# EasyEDA Pro project 定时喝水PCB.eprj, board 参考PCB1_1
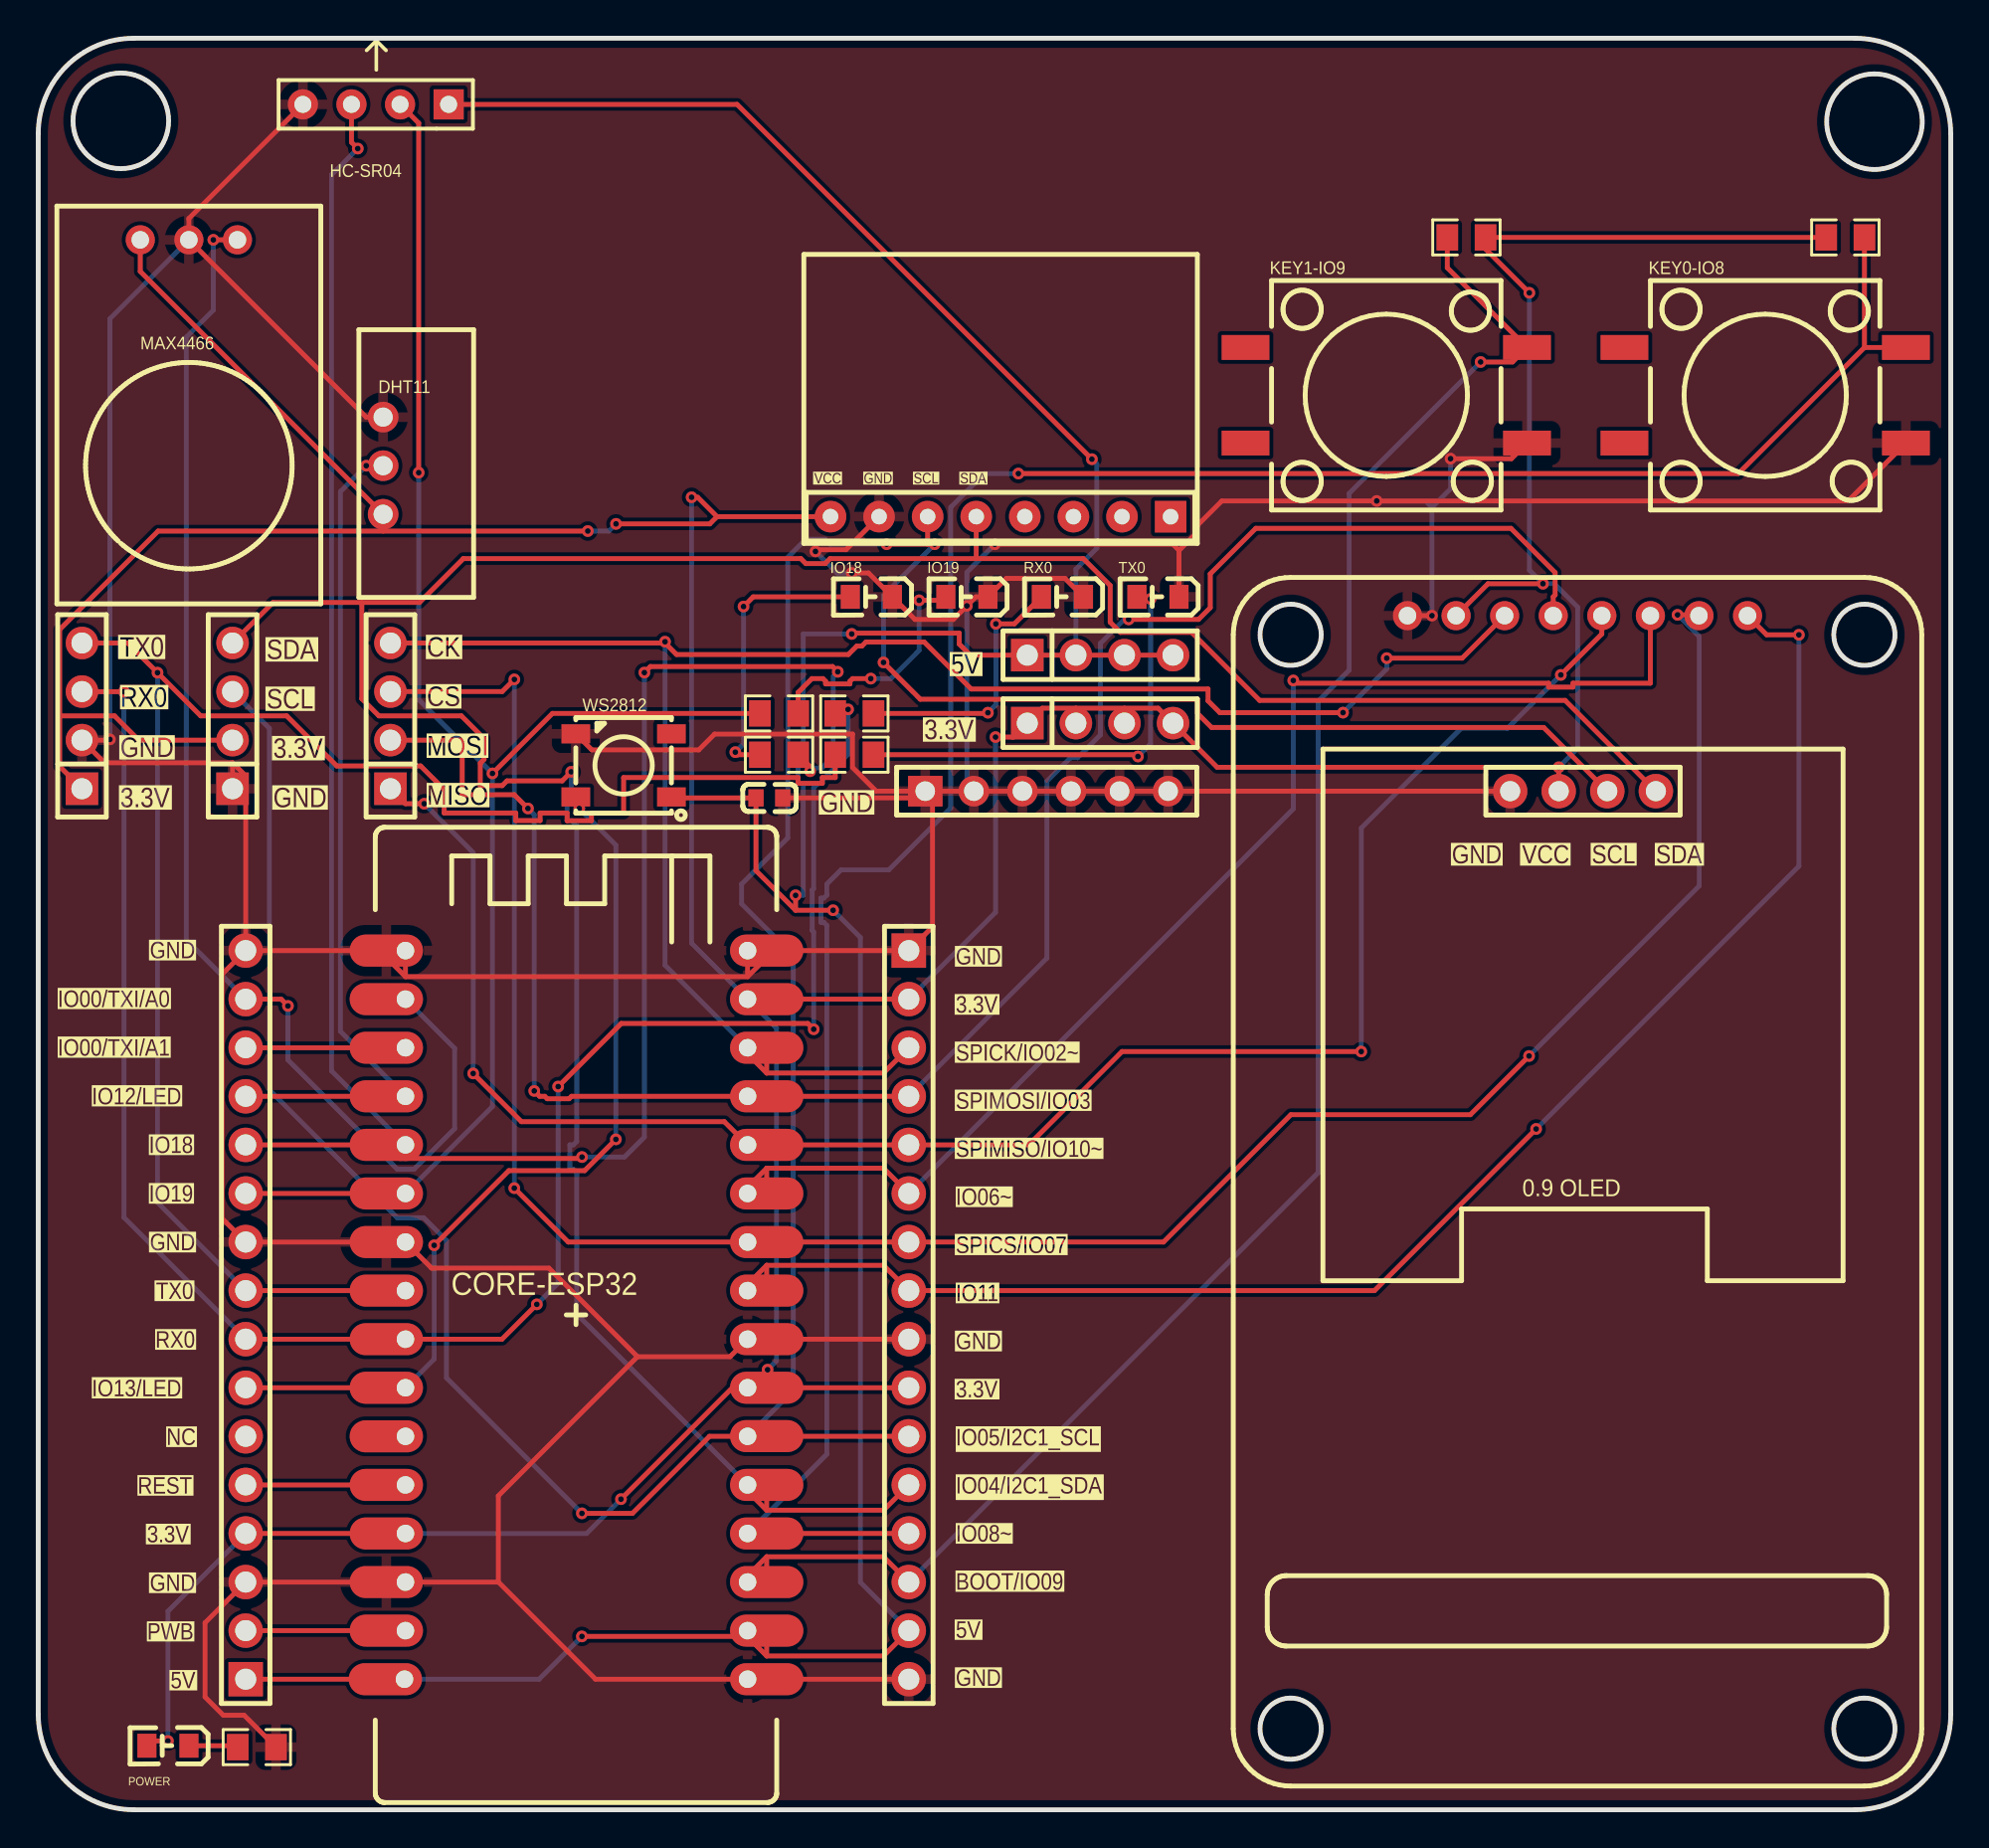
[diagram p4: board, top side]
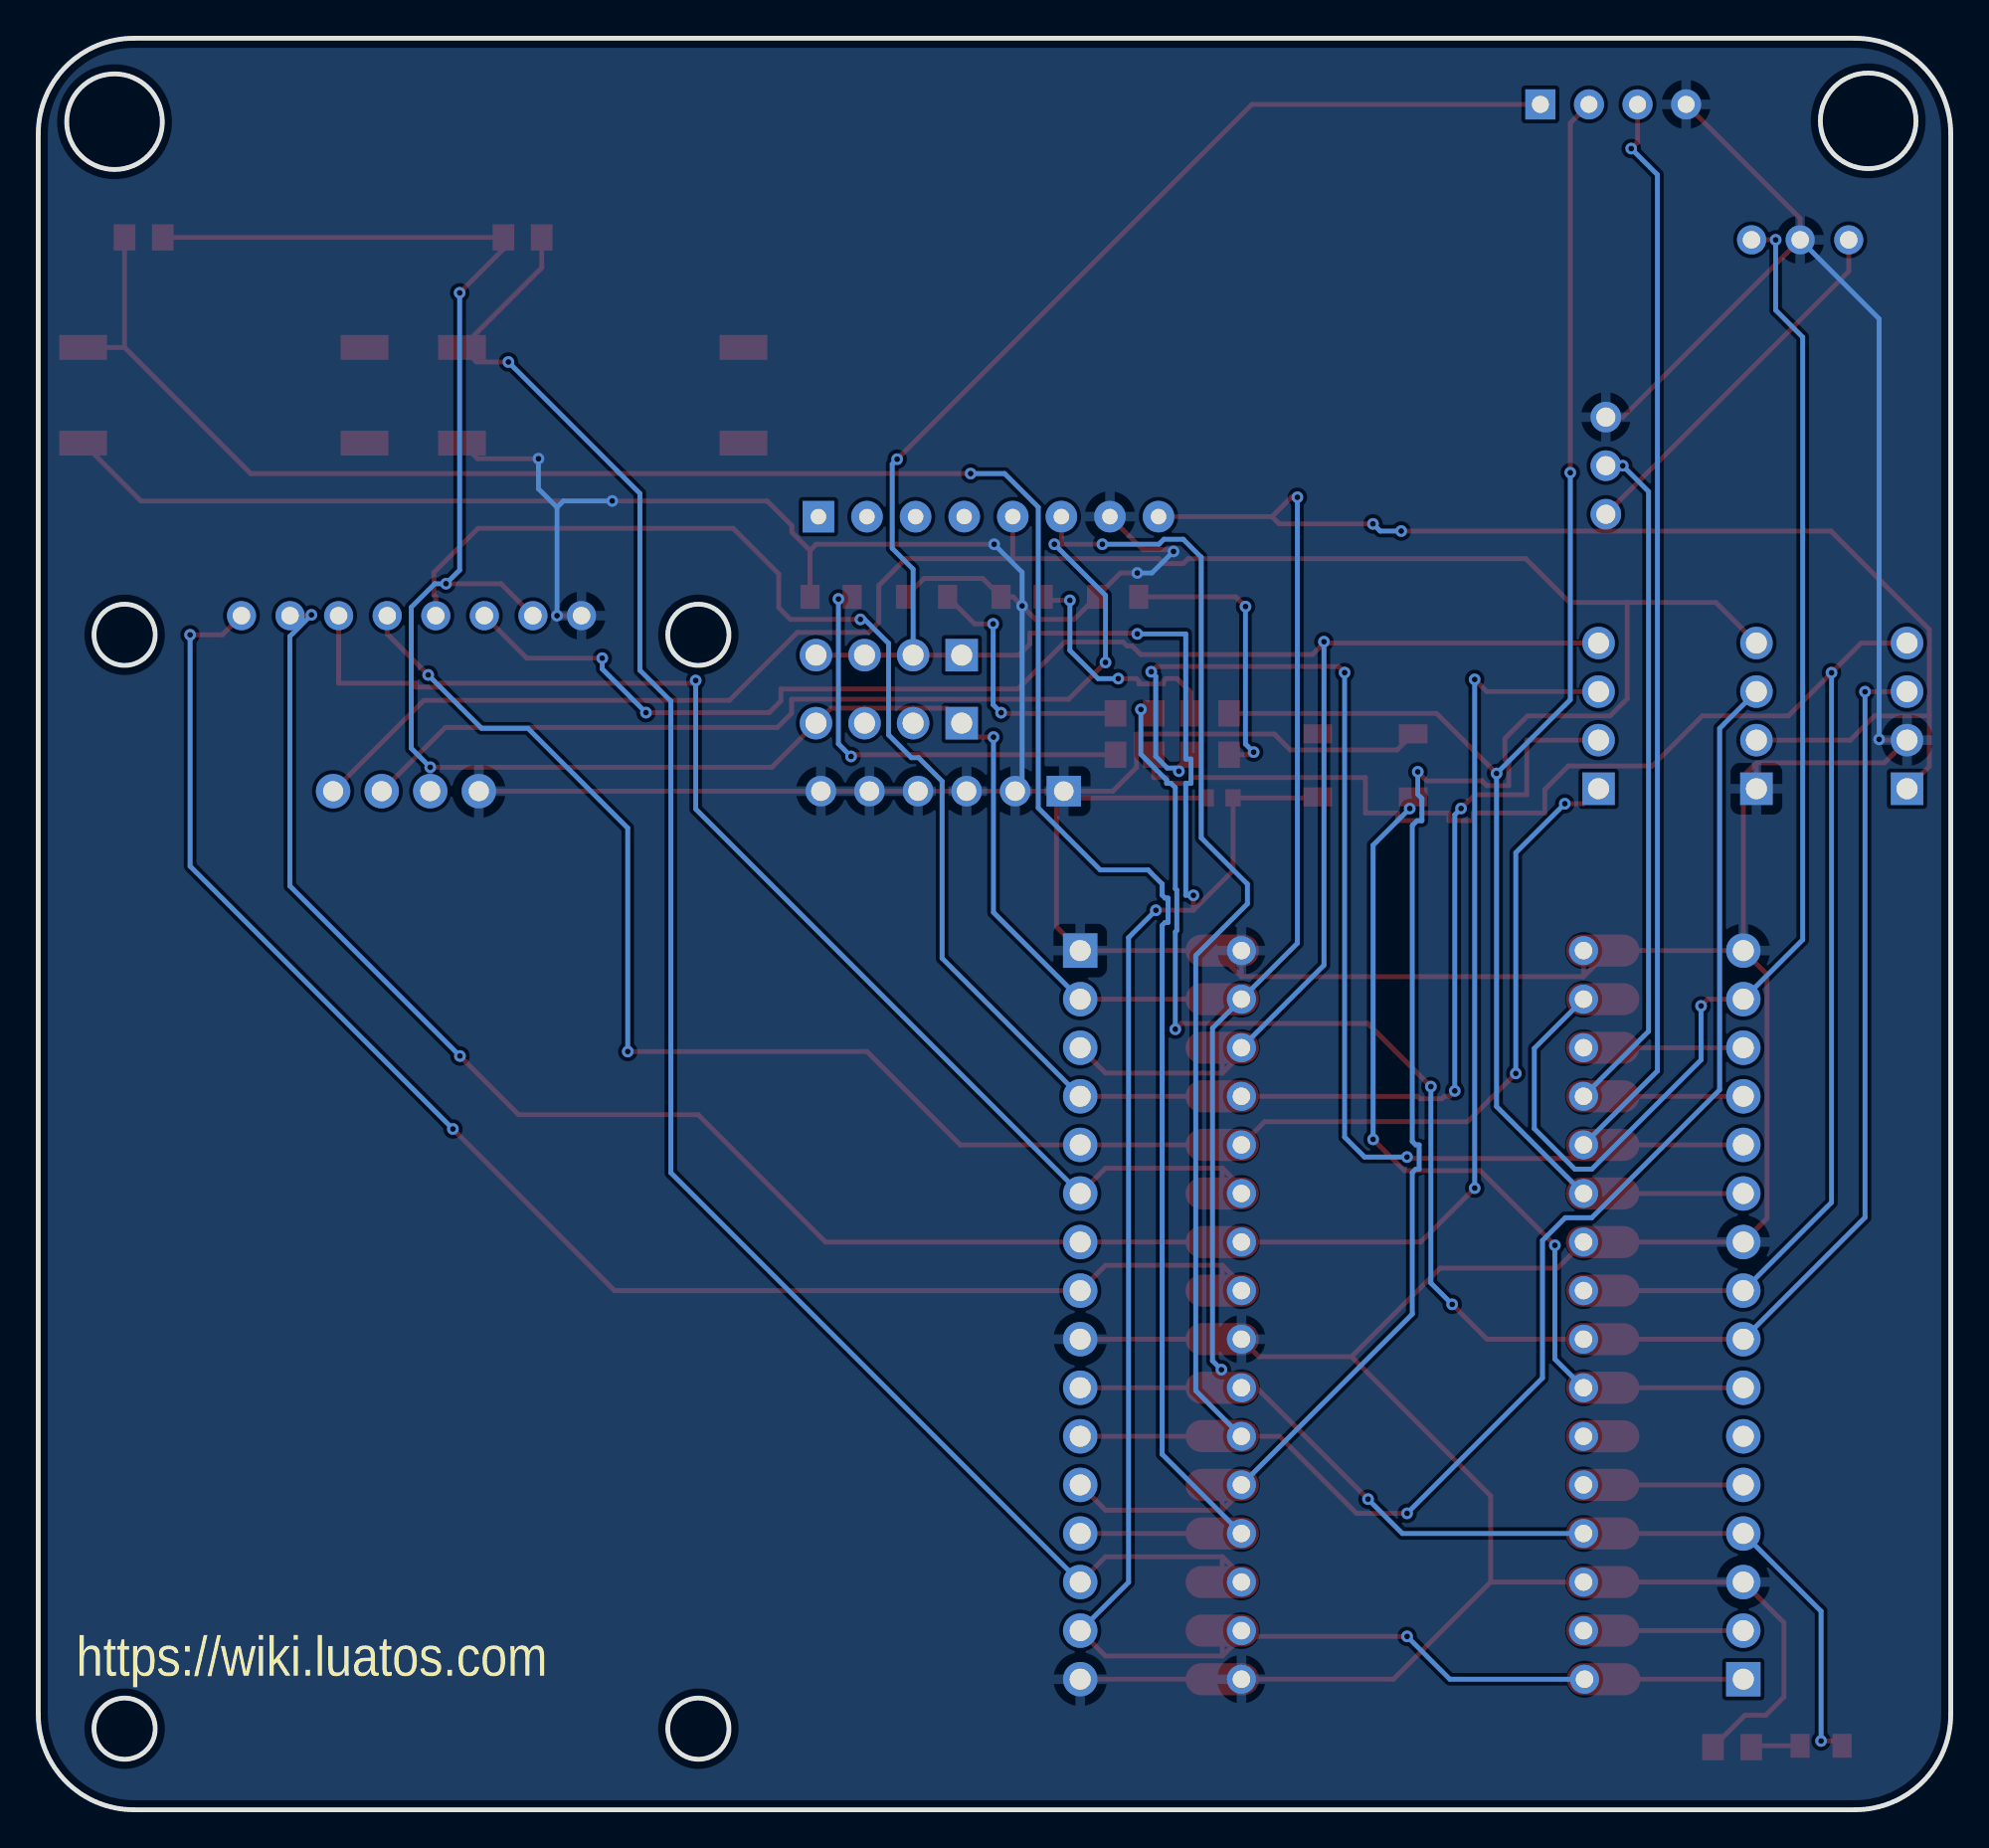
[diagram p5: board, bottom side, seen from below]

Outline 100 x 92.63 mm; copper layers: Top Layer, Bottom Layer. Coordinates in mm from the lower left corner of the outline.
Outline path: circle c4.32,88.32 r2.5 ; circle c65.48,61.44 r1.6 ; circle c65.48,4.24 r1.6 ; circle c95.48,61.44 r1.6 ; circle c95.48,4.24 r1.6 ; circle c96.01,88.27 r2.5 ; 0,87.63 arc(1.46,91.17) 5,92.63 95,92.63 arc(98.54,91.17) 100,87.63 100,5 arc(98.54,1.46) 95,0 5,0 arc(1.46,1.46) 0,5 0,87.63
Stack: SUBSTRATE1 0.32mm FR-4 er 4.8 / Bottom Layer 0.035mm

## Design rules (mm)
spacing safeClearance (default): track to track 0.152, other pairs 0.152 to 0.3
track width trackWidth (default): min 0.127, default 0.254, max 2.54
differential pair differentialPair (default): width min 0.127, default 0.254, max 2.54; gap min 0.152, default 0.152
via viaSize (default): diameter min 0.5, default 0.61, max 10; hole min 0.3, default 0.305, max 6

## Placement (name value [footprint] x y rotation side)
0.9 OLED  HS96L03W2C03  [OLED-TH_L27.8-W27.2-P2.54_C9900033791]  80.77 53.26 0 top
C1  CAP_0603  [C0603]  38.23 52.91 180 top
CORE-ESP32  ESP32C3-合宙  [esp32c3-合宙]  28.12 25.89 0 top
DHT11  -  [DHT11]  16.76 77.39 0 top
H1  HDR-M_2.54_1x16P  [HDR-TH_16P-P2.54-V-M]  10.85 25.88 90 top
H2  HDR-M_2.54_1x16P  [HDR-TH_16P-P2.54-V-M]  45.52 25.88 270 top
H4  HDR-M_2.54_1x4P  [HDR-TH_4P-P2.54-V-M]  55.53 60.38 0 top
H6  HDR-M_2.54_1x4P  [HDR-TH_4P-P2.54-V-M]  55.53 56.82 0 top
H7  HDR-F_2.54_1x6P  [HDR-TH_6P-P2.54-V-F]  52.73 53.26 0 top
H8  HDR-F_2.54_1x4P  [HDR-TH_4P-P2.54-V-F]  2.29 57.2 90 top
H9  HDR-F_2.54_1x4P  [HDR-TH_4P-P2.54-V-F]  10.16 57.2 90 top
H10  HDR-F_2.54_1x4P  [HDR-TH_4P-P2.54-V-F]  18.42 57.2 90 top
HC-SR04  -  [HC-SR04]  17.68 89.2 180 top
IMPORTED_IMAGE  -  [IMPORTED_IMAGE]  97.41 30.02 0 bottom
IO18  XL-2012SURC  [LED0805-RD_RED]  43.56 63.42 180 top
IO19  XL-2012SURC  [LED0805-RD_RED]  48.56 63.42 180 top
KEY0-IO8  SWS12X12  [SW-SMD_4P-L12.0-W12.0-P5.00-LS15.4]  90.3 73.96 180 top
KEY1-IO9  SWS12X12  [SW-SMD_4P-L12.0-W12.0-P5.00-LS15.4]  70.49 73.96 180 top
MAX4466  -  [MAX4466]  7.87 73.46 270 top
MPU6050  MPU6050模块  [MPU6050]  60.61 66.22 180 top
NOREF  -  [R0805]  38.74 57.33 180 top
POWER  LED_0805-R  [LED_0805]  6.73 3.35 180 top
R4  RC0805JR-0710KL  [R0805]  74.68 82.22 0 top
R5  RC0805JR-0710KL  [R0805]  94.49 82.22 180 top
R6  Res_0805  [R0805]  11.43 3.27 0 top
RX0  XL-2012SURC  [LED0805-RD_RED]  53.55 63.42 180 top
TX0  XL-2012SURC  [LED0805-RD_RED]  58.55 63.42 180 top
U2  SC0805F1001F4ANRH  [R0805]  42.67 55.17 180 top
U3  SC0805F1001F4ANRH  [R0805]  42.67 57.33 180 top
U4  SC0805F1001F4ANRH  [R0805]  38.74 55.17 0 top
U11  TFT_LCD_1.8INCH_SPI  [TFT_LCD_1.8INCH]  62.48 64.44 0 top
WS2812  WS2812E  [LED-SMD_4P-L5.0-W5.0-BL_TC5050RGB]  30.61 54.61 180 top

## Footprints (pads in the part's own frame, mm; a bottom-side part is the same pattern mirrored in y, then rotated)
C0603
  rect 0.8x0.9 smd: 1(-0.7,0) 2(0.7,0)
DHT11
  round 1.6 hole 1: 1(1.27,-9.652) 2(1.27,-7.112) 3(1.27,-4.572)
esp32c3-合宙
  oval 3.836x1.677 smd: 1(-9.918,19.038) 2(-9.918,16.498) 3(-9.918,13.958) 4(-9.918,11.418) 5(-9.918,8.878) 6(-9.918,6.338) 7(-9.918,3.798) 8(-9.918,1.258) 9(-9.918,-1.282) 10(-9.918,-3.822) 11(-9.918,-6.362) 12(-9.918,-8.902) 13(-9.918,-11.442) 14(-9.918,-13.982) 15(-9.918,-16.522) 16(-9.97,-19.062) 17(9.97,19.038) 18(9.97,16.498) 19(9.97,13.958) 20(9.97,11.418) 21(9.97,8.878) 22(9.97,6.338) 23(9.97,3.798) 24(9.97,1.258) 25(9.97,-1.282) 26(9.97,-3.822) 27(9.97,-6.35) 28(9.97,-8.902) 29(9.97,-11.442) 30(9.97,-13.982) 31(9.97,-16.522) 32(9.97,-19.062)
  round 1.524 hole 0.914: 1(-8.918,19.038) 2(-8.918,16.498) 3(-8.918,13.958) 4(-8.918,11.418) 5(-8.918,8.878) 6(-8.918,6.338) 7(-8.918,3.798) 8(-8.918,1.258) 9(-8.918,-1.282) 10(-8.918,-3.822) 11(-8.918,-6.362) 12(-8.918,-8.902) 13(-8.918,-11.442) 14(-8.918,-13.982) 15(-8.918,-16.522) 16(-8.97,-19.062) 17(8.97,19.038) 18(8.97,16.498) 19(8.97,13.958) 20(8.97,11.418) 21(8.97,8.878) 22(8.97,6.338) 23(8.97,3.798) 24(8.97,1.258) 25(8.97,-1.282) 26(8.97,-3.822) 27(8.97,-6.362) 28(8.97,-8.902) 29(8.97,-11.442) 30(8.97,-13.982) 31(8.97,-16.522) 32(8.97,-19.062)
HC-SR04
  rect 1.575x1.575 hole 0.889: 1(-3.78,0.03)
  round 1.575 hole 0.889: 2(-1.24,0.03) 3(1.3,0.03) 4(3.84,0.03)
HDR-TH_4P-P2.54-V-F
  rect 1.7x1.7 hole 1.1: 1(-3.81,0)
  round 1.7 hole 1.1: 2(-1.27,0) 3(1.27,0) 4(3.81,0)
HDR-TH_4P-P2.54-V-M
  rect 1.7x1.7 hole 1.1: 1(-3.81,0)
  round 1.7 hole 1.1: 2(-1.27,0) 3(1.27,0) 4(3.81,0)
HDR-TH_6P-P2.54-V-F
  rect 1.8x1.6 hole 1.02: 1(-6.35,0)
  round 1.6 hole 1.02: 2(-3.81,0) 3(-1.27,0) 4(1.27,0) 5(3.81,0) 6(6.35,0)
HDR-TH_16P-P2.54-V-M
  rect 1.8x1.8 hole 1.1: 1(-19.05,0)
  round 1.8 hole 1.1: 2(-16.51,0) 3(-13.97,0) 4(-11.43,0) 5(-8.89,0) 6(-6.35,0) 7(-3.81,0) 8(-1.27,0) 9(1.27,0) 10(3.81,0) 11(6.35,0) 12(8.89,0) 13(11.43,0) 14(13.97,0) 15(16.51,0) 16(19.05,0)
LED0805-RD_RED
  rect 1x1.25 smd: 1(-1.1,0) 2(1.1,0)
LED-SMD_4P-L5.0-W5.0-BL_TC5050RGB
  rect 1.5x1 smd: 1(-2.5,1.65) 2(-2.5,-1.65) 3(2.5,-1.65) 4(2.5,1.65)
LED_0805
  rect 1x1.25 smd: 1(-1.15,0.005) 2(1.05,0.005)
MAX4466
  round 1.524 hole 0.914: 1(-8.636,2.54) 2(-8.636,0) 3(-8.636,-2.54)
MPU6050
  rect 1.651x1.651 hole 0.81: 1(1.397,-1.397)
  round 1.651 hole 0.81: 2(3.938,-1.399) 3(6.478,-1.399) 4(9.021,-1.401) 5(11.56,-1.401) 6(14.101,-1.401) 7(16.64,-1.401) 8(19.18,-1.401)
OLED-TH_L27.8-W27.2-P2.54_C9900033791
  round 1.8 hole 1.05: 1(-3.81,0) 2(-1.27,0) 3(1.27,0) 4(3.81,0)
R0805
  rect 1.133x1.377 smd: 1(-1,0) 2(1,0)
SW-SMD_4P-L12.0-W12.0-P5.00-LS15.4
  rect 2.499x1.3 smd: 1(7.359,-2.499) 2(-7.359,-2.499) 3(7.359,2.499) 4(-7.359,2.499)
TFT_LCD_1.8INCH
  round 1.524 hole 0.914: 1(9.11,-2) 2(11.65,-2) 3(14.19,-2) 4(16.73,-2) 5(19.27,-2) 6(21.81,-2) 7(24.35,-2) 8(26.89,-2)

## Nets
3.3V: 0.9 OLED.2 CORE-ESP32.13 CORE-ESP32.18 CORE-ESP32.26 DHT11.1 H1.4 H2.2 H2.10 H6.1 H6.2 H6.3 H6.4 H8.1 H9.2 MAX4466.3 MPU6050.8 POWER.2 R4.2 R5.2 U11.2
+5V: C1.2 CORE-ESP32.16 CORE-ESP32.31 H1.1 H2.15 H4.1 H4.2 H4.3 H4.4 HC-SR04.1 WS2812.1
GND: 0.9 OLED.1 C1.1 CORE-ESP32.1 CORE-ESP32.7 CORE-ESP32.14 CORE-ESP32.17 CORE-ESP32.25 CORE-ESP32.32 DHT11.3 H1.3 H1.10 H1.16 H2.1 H2.9 H2.16 H7.1 H7.2 H7.3 H7.4 H7.5 H7.6 H8.2 H9.1 HC-SR04.4 IO18.1 IO19.1 KEY0-IO8.4 KEY1-IO9.4 MAX4466.2 MPU6050.7 R6.2 RX0.1 TX0.1 U11.1 WS2812.3
BOOT/IO09: CORE-ESP32.30 H2.14 KEY1-IO9.2 R4.1
IO00/TXI/A0: CORE-ESP32.2 H1.15 MAX4466.1
IO01/RX1/A1: CORE-ESP32.3 H1.14
IO04/I2C1_SDA: 0.9 OLED.4 CORE-ESP32.28 H2.12 H9.4 MPU6050.5
IO05/I2C1_SCL: 0.9 OLED.3 CORE-ESP32.27 H2.11 H9.3 MPU6050.6
IO06: CORE-ESP32.22 H2.6 U11.6
IO08: CORE-ESP32.29 H2.13 KEY0-IO8.2 R5.1
IO11: CORE-ESP32.24 H2.8 U11.8
IO12/LED: CORE-ESP32.4 DHT11.2 H1.13
IO13/LED: CORE-ESP32.10 H1.7 WS2812.4
IO18: CORE-ESP32.5 H1.12 HC-SR04.3 U4.2
IO19: CORE-ESP32.6 H1.11 HC-SR04.2 NOREF.2
PWB: CORE-ESP32.15 H1.2
REST: CORE-ESP32.12 H1.5
RX0: CORE-ESP32.9 H1.8 H8.3 U3.2
SPICK/IO02: CORE-ESP32.19 H2.3 H10.4 U11.3
SPICS/IO07: CORE-ESP32.23 H2.7 H10.3 U11.7
SPIMISO/IO10: CORE-ESP32.21 H2.5 H10.1 U11.5
SPIMOSI/IO03: CORE-ESP32.20 H2.4 H10.2 U11.4
TX0: CORE-ESP32.8 H1.9 H8.4 U2.2
$1N1721: TX0.2 U2.1
$1N1722: RX0.2 U3.1
$1N1727: IO18.2 U4.1
$1N1728: IO19.2 NOREF.1
$1N11704: POWER.1 R6.1

Pads without a net: CORE-ESP32 11; H1 6; KEY0-IO8 1 3; KEY1-IO9 1 3; MPU6050 1 2 3 4; WS2812 2

## Via types
v1: diameter 0.61, hole 0.305, Top Layer to Bottom Layer, 74 vias

## Routing (per net, layer and track width the routed paths; a pad name or vN(x,y) marks a point on that pad's centre or on a via; arc(x,y) is an arc through that point)
3.3V: length 295.2
  Top Layer w0.254: v1(34.16,68.63) 34.48,68.63 35.49,67.62 ; H1.4 CORE-ESP32.13 CORE-ESP32.13 ; H9.2 5.26,55.93 3.99,57.2 1.12,57.2 ; H8.1 1.12,54.56 1.12,57.2 ; v1(38.13,23.01) 38.13,22.07 ; 38.13,22.07 H2.10 ; 38.13,22.07 CORE-ESP32.26 CORE-ESP32.26 36.29,22.07 v1(30.47,16.24) ; 35.49,67.62 MPU6050.8 ; 35.49,67.62 35.11,67.24 v1(30.21,67.24) ; 56.8,57.6 58.55,57.6 H6.4 61.64,54.51 v1(79.5,54.51) 0.9 OLED.2 ; 56.8,57.6 H6.3 ; 56.8,57.6 54.25,57.6 ; R5.2 R4.2 75.68,81.61 v1(77.97,79.32) ; 18.03,66.86 6.27,66.86 1.12,61.72 1.12,57.2 ; 18.03,66.86 DHT11.1 5.33,80.44 MAX4466.3 ; 18.03,66.86 v1(28.73,66.86) ; 54.25,57.6 52.5,57.6 H6.1 50.99,56.09 v1(50.05,56.09) ; 54.25,57.6 H6.2 ; v1(6.78,3.6) 5.93,3.6 POWER.2 ; H2.2 CORE-ESP32.18 CORE-ESP32.18 ; U11.2 75.8,64.11 v1(78.68,64.11)
  Bottom Layer w0.254: CORE-ESP32.13 28.67,14.45 v1(30.47,16.24) ; v1(6.78,3.6) 6.78,10.38 H1.4 ; H2.2 50.05,46.92 v1(50.05,56.09) ; v1(38.13,23.01) 38.6,23.48 38.6,40.87 CORE-ESP32.18 34.16,45.31 v1(34.16,68.63) ; v1(79.5,54.51) 80.5,55.51 80.5,62.88 79.27,64.11 v1(78.68,64.11) 77.97,64.82 v1(77.97,79.32) ; v1(28.73,66.86) 29.84,66.86 v1(30.21,67.24)
+5V: length 178.3
  Top Layer w0.254: WS2812.1 33.16,52.91 C1.2 37.53,49.11 39.6,47.04 ; v1(28.43,9.06) 37.09,9.06 ; 37.09,9.06 37.09,9.04 38.09,8.04 ; 37.09,9.06 CORE-ESP32.31 ; 39.6,47.04 v1(39.6,47.82) ; 39.6,47.04 v1(41.56,47.04) ; H1.1 CORE-ESP32.16 CORE-ESP32.16 ; v1(55.09,70.62) 36.54,89.17 HC-SR04.1 ; H4.4 H4.3 H4.2 H4.1 48.73,60.38 48.16,60.95 48.16,61.53 42.58,61.53 v1(42.53,61.49) ; H2.15 44.19,8.04 38.09,8.04 ; 38.09,8.04 CORE-ESP32.31
  Bottom Layer w0.254: v1(39.6,47.82) 40,47.82 40,53.67 39.72,53.67 39.72,54.94 40,54.94 40,61.49 v1(42.53,61.49) ; H4.2 54.25,64.87 55.35,65.96 55.35,70.36 v1(55.09,70.62) ; H2.15 42.99,11.89 42.99,45.61 v1(41.56,47.04) ; CORE-ESP32.16 26.19,6.83 v1(28.43,9.06)
GND: length 401.5
  Top Layer w0.254: 19.2,43.56 CORE-ESP32.1 ; 19.2,43.56 18.2,44.56 CORE-ESP32.1 H1.16 ; 19.2,43.56 37.09,43.56 ; 10.16,54.75 3.47,54.75 H8.2 3.7,55.93 v1(3.75,55.97) ; 10.16,54.75 H9.1 ; 10.16,54.75 10.85,54.06 H1.16 ; DHT11.3 17.15,72.82 MAX4466.2 7.87,83.21 HC-SR04.4 ; H1.16 9.61,43.69 9.61,30.93 H1.10 CORE-ESP32.7 CORE-ESP32.7 20.56,28.32 26.7,28.32 31.33,23.69 ; 31.33,23.69 24.06,16.42 24.06,11.91 ; 31.33,23.69 36.17,23.69 CORE-ESP32.25 CORE-ESP32.25 H2.9 ; v1(72.88,62.44) U11.1 ; 46.76,53.26 H7.2 H7.3 H7.5 H7.6 0.9 OLED.1 ; 46.76,53.26 46.76,46.17 H2.1 CORE-ESP32.17 38.09,44.56 37.09,43.56 ; 46.76,53.26 H7.1 ; 37.09,43.56 CORE-ESP32.17 ; v1(42.53,64.67) 43.41,64.67 IO18.1 45.84,62.24 47.85,62.24 v1(48.56,62.95) 49.03,63.42 IO19.1 50.62,64.39 53.69,64.39 RX0.1 ; 24.06,11.91 CORE-ESP32.14 CORE-ESP32.14 H1.3 8.72,9.78 8.72,5.9 9.68,4.94 10.76,4.94 R6.2 ; 24.06,11.91 29.14,6.83 CORE-ESP32.32 CORE-ESP32.32 H2.16 ; KEY0-IO8.4 94.63,68.44 v1(69.99,68.44) 61.89,68.44 60.59,67.14 60.59,66.8 59.65,65.85 ; H7.1 43.81,53.26 42.58,54.5 42.58,56.25 35.36,56.25 34.54,55.42 28.95,55.42 WS2812.3 ; H7.1 46.03,52.91 C1.1 ; MPU6050.7 42.24,65.89 40.73,65.89 v1(40.64,65.8) ; v1(73.85,70.65) 77.03,70.65 KEY1-IO9.4 ; TX0.1 59.65,65.85 ; 59.65,65.85 59.32,66.17 v1(50.02,66.17)
  Bottom Layer w0.254: MAX4466.2 3.75,77.96 v1(3.75,55.97) ; H7.2 48.56,53.63 v1(48.56,62.95) 48.56,64.71 v1(50.02,66.17) ; 72.88,68.1 v1(72.88,62.44) ; 72.88,68.1 72.54,68.44 v1(69.99,68.44) ; 72.88,68.1 73.85,69.07 v1(73.85,70.65) ; v1(42.53,64.67) 41.77,64.67 v1(40.64,65.8)
BOOT/IO09: length 97.4
  Top Layer w0.254: CORE-ESP32.30 37.09,12.23 38.09,13.23 ; R4.1 73.68,80.63 KEY1-IO9.2 77.08,75.71 v1(75.42,75.71) ; 38.09,13.23 CORE-ESP32.30 ; 38.09,13.23 44.19,13.23 H2.14
  Bottom Layer w0.254: H2.14 66.92,33.31 66.92,57.97 68.54,59.59 68.54,68.83 v1(75.42,75.71)
IO00/TXI/A0: length 68.8
  Top Layer w0.254: H1.15 12.7,42.39 v1(13.06,42.03) ; CORE-ESP32.2 CORE-ESP32.2 ; v1(9.16,82.09) MAX4466.1
  Bottom Layer w0.254: CORE-ESP32.2 21.77,39.81 21.77,35.62 19.65,33.5 18.77,33.5 13.06,39.21 v1(13.06,42.03) ; H1.15 7.74,45.49 7.74,77 9.16,78.42 v1(9.16,82.09)
IO01/RX1/A1: length 8.4
  Top Layer w0.254: H1.14 CORE-ESP32.3 CORE-ESP32.3
IO04/I2C1_SDA: length 157.7
  Top Layer w0.254: v1(27.87,54.27) 27.39,53.8 24.51,53.8 24.26,53.55 23.11,53.55 23.11,54.73 23.31,54.93 23.31,56.01 22.12,57.2 17.81,57.2 16.92,58.09 16.92,63.13 ; 16.92,63.13 19.93,63.13 22.23,65.42 39.87,65.42 40.13,65.16 41.14,65.16 41.41,65.42 49.04,65.42 ; 16.92,63.13 12.28,63.13 H9.4 ; CORE-ESP32.28 37.09,16.66 38.09,15.66 ; 38.09,15.66 44.19,15.66 H2.12 ; 38.09,15.66 CORE-ESP32.28 ; 49.04,65.42 MPU6050.5 ; 49.04,65.42 54.64,65.42 56.05,64.02 56.05,62.1 56.58,61.57 60.31,61.57 63.86,58.01 79.84,58.01 0.9 OLED.4
  Bottom Layer w0.254: CORE-ESP32.28 28.16,25.92 28.16,33.32 27.98,33.5 27.8,33.5 27.8,34.77 27.98,34.77 28.16,34.95 28.16,51.47 27.9,51.72 27.65,51.72 27.65,52.88 27.87,53.1 v1(27.87,54.27)
IO05/I2C1_SCL: length 177.2
  Top Layer w0.254: H2.11 38.1,19.53 CORE-ESP32.27 37.1,19.54 CORE-ESP32.27 35.1,19.53 31.07,15.5 v1(28.43,15.5) ; v1(44.2,59.99) 46.12,58.07 60.61,58.07 60.61,57.33 61.35,56.59 78.71,56.59 0.9 OLED.3 ; 46.5,66.18 v1(44.36,66.18) ; 46.5,66.18 v1(46.87,66.18) ; 46.5,66.18 MPU6050.6
  Bottom Layer w0.254: H9.3 12.09,56.54 12.09,37.64 18.77,30.96 20.16,30.96 21.35,29.77 21.35,22.58 v1(28.43,15.5) ; v1(46.87,66.18) 44.2,63.5 v1(44.2,59.99) ; v1(44.36,66.18) 41.41,66.18 41.14,66.44 40.13,66.44 39.19,65.49 39.19,50.82 36.78,48.4 36.78,47.37 39.48,44.67 39.48,21.92 CORE-ESP32.27
IO06: length 68.9
  Top Layer w0.254: 38.09,33.55 CORE-ESP32.22 ; 38.09,33.55 37.09,32.55 CORE-ESP32.22 ; 38.09,33.55 44.19,33.55 H2.6 ; v1(65.62,59.05) 65.62,58.91 78.98,58.91 78.98,58.7 80.25,58.7 80.25,58.91 84.29,58.91 U11.6
  Bottom Layer w0.254: H2.6 65.62,52.33 v1(65.62,59.05)
IO08: length 127.6
  Top Layer w0.254: 95.49,76.46 R5.1 ; 95.49,76.46 88.89,69.87 v1(51.25,69.87) ; 95.49,76.46 KEY0-IO8.2 ; H2.13 CORE-ESP32.29 CORE-ESP32.29
  Bottom Layer w0.254: v1(51.25,69.87) 49.47,69.87 47.71,68.11 47.71,52.38 44.47,49.15 41.97,49.15 41.23,48.41 41.23,47.83 41.08,47.67 40.93,47.67 40.93,46.4 41.08,46.4 41.23,46.25 41.23,18.59 CORE-ESP32.29
IO11: length 82
  Top Layer w0.254: U11.8 90.38,61.44 v1(92.06,61.44) ; 38.09,28.47 CORE-ESP32.24 ; 38.09,28.47 44.19,28.47 H2.8 69.87,27.15 v1(78.32,35.6) ; 38.09,28.47 37.09,27.47 CORE-ESP32.24
  Bottom Layer w0.254: v1(92.06,61.44) 92.06,49.34 v1(78.32,35.6)
IO12/LED: length 44.2
  Top Layer w0.254: CORE-ESP32.4 CORE-ESP32.4 H1.13 ; v1(17.15,70.28) DHT11.2
  Bottom Layer w0.254: CORE-ESP32.4 15.8,40.71 15.8,68.93 v1(17.15,70.28)
IO13/LED: length 47
  Top Layer w0.254: v1(30.2,35.06) 28.57,33.42 24.61,33.42 v1(20.7,29.51) ; CORE-ESP32.10 CORE-ESP32.10 H1.7 ; WS2812.4 28.29,52.78 v1(28.29,52.35)
  Bottom Layer w0.254: v1(20.7,29.51) 20.7,23.57 CORE-ESP32.10 ; v1(30.2,35.06) 30.2,50.44 v1(28.29,52.35)
IO18: length 120.8
  Top Layer w0.254: v1(41.81,59.51) 41.53,59.78 32.01,59.78 v1(31.69,59.46) ; v1(40.36,54.31) 40.36,54.54 U4.2 ; 19.2,34.06 28.36,34.06 v1(28.43,34.13) ; 19.2,34.06 CORE-ESP32.5 ; 19.2,34.06 18.91,34.06 CORE-ESP32.5 H1.12 ; v1(16.71,86.87) 16.38,87.2 HC-SR04.3
  Bottom Layer w0.254: CORE-ESP32.5 15.34,38.63 15.34,85.5 v1(16.71,86.87) ; v1(41.81,59.51) 41.57,59.27 41.57,55.08 40.97,54.47 40.53,54.47 v1(40.36,54.31) ; v1(28.43,34.13) 30.65,34.13 31.69,35.17 v1(31.69,59.46)
IO19: length 84.5
  Top Layer w0.254: HC-SR04.2 19.89,88.2 v1(19.89,69.92) ; v1(23.75,54.19) 26.89,57.33 NOREF.2 ; H1.11 CORE-ESP32.6 CORE-ESP32.6
  Bottom Layer w0.254: v1(19.89,69.92) 19.89,58.04 v1(23.75,54.19) 23.75,36.77 CORE-ESP32.6
PWB: length 8.4
  Top Layer w0.254: CORE-ESP32.15 CORE-ESP32.15 H1.2
REST: length 8.4
  Top Layer w0.254: CORE-ESP32.12 CORE-ESP32.12 H1.5
RX0: length 99.8
  Top Layer w0.254: v1(42.34,57.54) 41.88,57.54 U3.2 ; v1(4.48,58.46) 2.29,58.46 H8.3 ; v1(40.55,40.81) 40.24,41.12 30.48,41.12 v1(27.18,37.82) ; H1.8 CORE-ESP32.9 CORE-ESP32.9 24.25,24.61 v1(26.07,26.43)
  Bottom Layer w0.254: v1(42.34,57.54) 42.34,55.19 41,53.84 41,53.67 40.77,53.67 40.55,53.45 40.55,48.17 40.47,48.09 40.47,45.98 40.55,45.9 v1(40.55,40.81) ; v1(26.07,26.43) 27.18,27.54 v1(27.18,37.82) ; H1.8 4.48,30.97 v1(4.48,58.46)
SPICK/IO02: length 97.2
  Top Layer w0.254: 32.77,61.01 H10.4 ; 32.77,61.01 33.38,60.41 42.36,60.41 42.8,60.85 43.06,60.85 43.28,61.06 46.32,61.06 48.78,58.61 61.16,58.61 61.16,57.99 61.78,57.37 v1(68.22,57.37) ; 32.77,61.01 v1(32.77,61.08) ; U11.3 74.45,60.22 v1(70.51,60.22) ; 38.09,38.52 44.19,38.52 H2.3 ; 38.09,38.52 CORE-ESP32.19 ; 38.09,38.52 37.09,39.52 CORE-ESP32.19
  Bottom Layer w0.254: v1(70.51,60.22) 70.51,59.66 v1(68.22,57.37) ; v1(32.77,61.08) 32.77,44.16 CORE-ESP32.19
SPICS/IO07: length 120
  Top Layer w0.254: v1(85.72,62.48) 86.79,62.48 U11.7 ; v1(77.95,39.41) 74.88,36.35 65.5,36.35 58.84,29.69 H2.7 CORE-ESP32.23 CORE-ESP32.23 27.71,29.69 v1(24.89,32.51) ; H10.3 24.26,58.47 v1(24.89,59.11)
  Bottom Layer w0.254: v1(85.72,62.48) 86.84,61.35 86.84,48.31 v1(77.95,39.41) ; v1(24.89,59.11) 24.89,59.1 v1(24.89,32.51)
SPIMISO/IO10: length 96.7
  Top Layer w0.254: U11.5 81.75,61.48 v1(79.61,59.34) ; H10.1 19.2,52.61 v1(20.18,52.61) ; v1(69.18,39.65) 56.67,39.65 51.79,34.77 H2.5 CORE-ESP32.21 CORE-ESP32.21 35.87,35.98 25.26,35.98 v1(22.74,38.5)
  Bottom Layer w0.254: v1(69.18,39.65) 69.18,51.33 74.39,56.55 76.82,56.55 v1(79.61,59.34) ; v1(20.18,52.61) 22.74,50.05 v1(22.74,38.5)
SPIMOSI/IO03: length 103.7
  Top Layer w0.254: v1(25.93,37.59) 26.21,37.31 26.48,37.31 26.61,37.18 27.76,37.18 27.88,37.31 CORE-ESP32.20 CORE-ESP32.20 H2.4 ; v1(57.01,62.25) 60.67,62.25 61.28,62.86 61.28,64.63 63.66,67.01 77,67.01 79.31,64.7 79.31,63.52 79.21,63.42 U11.4 ; v1(25.61,52.36) 24.89,53.08 22.17,53.08 22.17,55.93 H10.2
  Bottom Layer w0.254: H2.4 52.74,44.53 52.74,53.78 53.97,55.01 54.35,55.01 55.54,56.2 55.54,60.99 56.79,62.25 v1(57.01,62.25) ; v1(25.61,52.36) 25.93,52.03 v1(25.93,37.59)
TX0: length 91.6
  Top Layer w0.254: H1.9 CORE-ESP32.8 CORE-ESP32.8 ; H8.4 4.68,61.01 v1(6.24,59.46) 8.49,57.2 12.99,57.2 15.61,54.58 20,54.58 21.22,53.35 21.22,52.12 24.97,52.12 24.97,51.72 26.24,51.72 26.24,52.12 27.65,52.12 27.65,51.72 28.92,51.72 28.92,52.12 30.61,52.12 30.61,53.97 39.72,53.97 39.72,53.67 41,53.67 41,53.97 41.67,53.97 U2.2
  Bottom Layer w0.254: v1(6.24,59.46) 6.24,31.76 H1.9
$1N1721: length 23.1
  Top Layer w0.254: TX0.2 57.56,63.31 v1(58.16,63.31) ; U2.1 57.41,55.17 v1(57.5,55.08)
  Bottom Layer w0.254: v1(57.5,55.08) 58.16,55.74 v1(58.16,63.31)
$1N1722: length 13.8
  Top Layer w0.254: RX0.2 51.04,62.01 v1(50.07,62.01) ; U3.1 49.62,57.33 v1(49.65,57.37)
  Bottom Layer w0.254: v1(49.65,57.37) 50.07,57.78 v1(50.07,62.01)
$1N1727: length 14.9
  Top Layer w0.254: U4.1 36.58,55.17 v1(36.45,55.3) ; v1(36.88,62.92) 37.38,63.42 IO18.2
  Bottom Layer w0.254: v1(36.88,62.92) 36.88,55.73 v1(36.45,55.3)
$1N1728: length 12.8
  Top Layer w0.254: v1(43.53,59.15) 42.58,59.15 42.44,59.01 42.44,58.87 41.17,58.87 41.17,59.01 41.03,59.15 40.45,59.15 39.74,58.43 NOREF.1 ; v1(46.06,63.24) 47.28,63.24 IO19.2
  Bottom Layer w0.254: v1(46.06,63.24) 46.06,60.62 44.58,59.15 v1(43.53,59.15)
$1N11704: length 2.6
  Top Layer w0.254: R6.1 10.36,3.35 POWER.1

## Copper pours and planes (outline as drawn; the poured copper is in the pictures)
GND on Top Layer: -7.62,-5.28 102.74,-5.28 102.74,97.59 -7.62,97.59
GND on Bottom Layer: -11.43,-12.9 113.03,-12.9 113.03,101.14 -11.43,101.14

## Text on the board
Bottom Silkscreen Layer: https://wiki.luatos.com
Top Silkscreen Layer: VCC | GND | SCL | SDA | IO00/TXI/A0 | IO00/TXI/A1 | IO12/LED | IO13/LED | REST | 3.3V | PWB | IO18 | IO19 | RX0 | TX0 | NC | 5V | SPICK/IO02~ | SPIMOSI/IO03 | SPIMISO/IO10~ | IO06~ | SPICS/IO07 | IO11 | IO05/I2C1_SCL | IO04/I2C1_SDA | IO08~ | BOOT/IO09 | CK | CS | MOSI | MISO
